# EasyEDA Pro project Cerberus_Sub_Controller_v01.eprj, board Cerberus_Sub_Controller_v01 (continued)
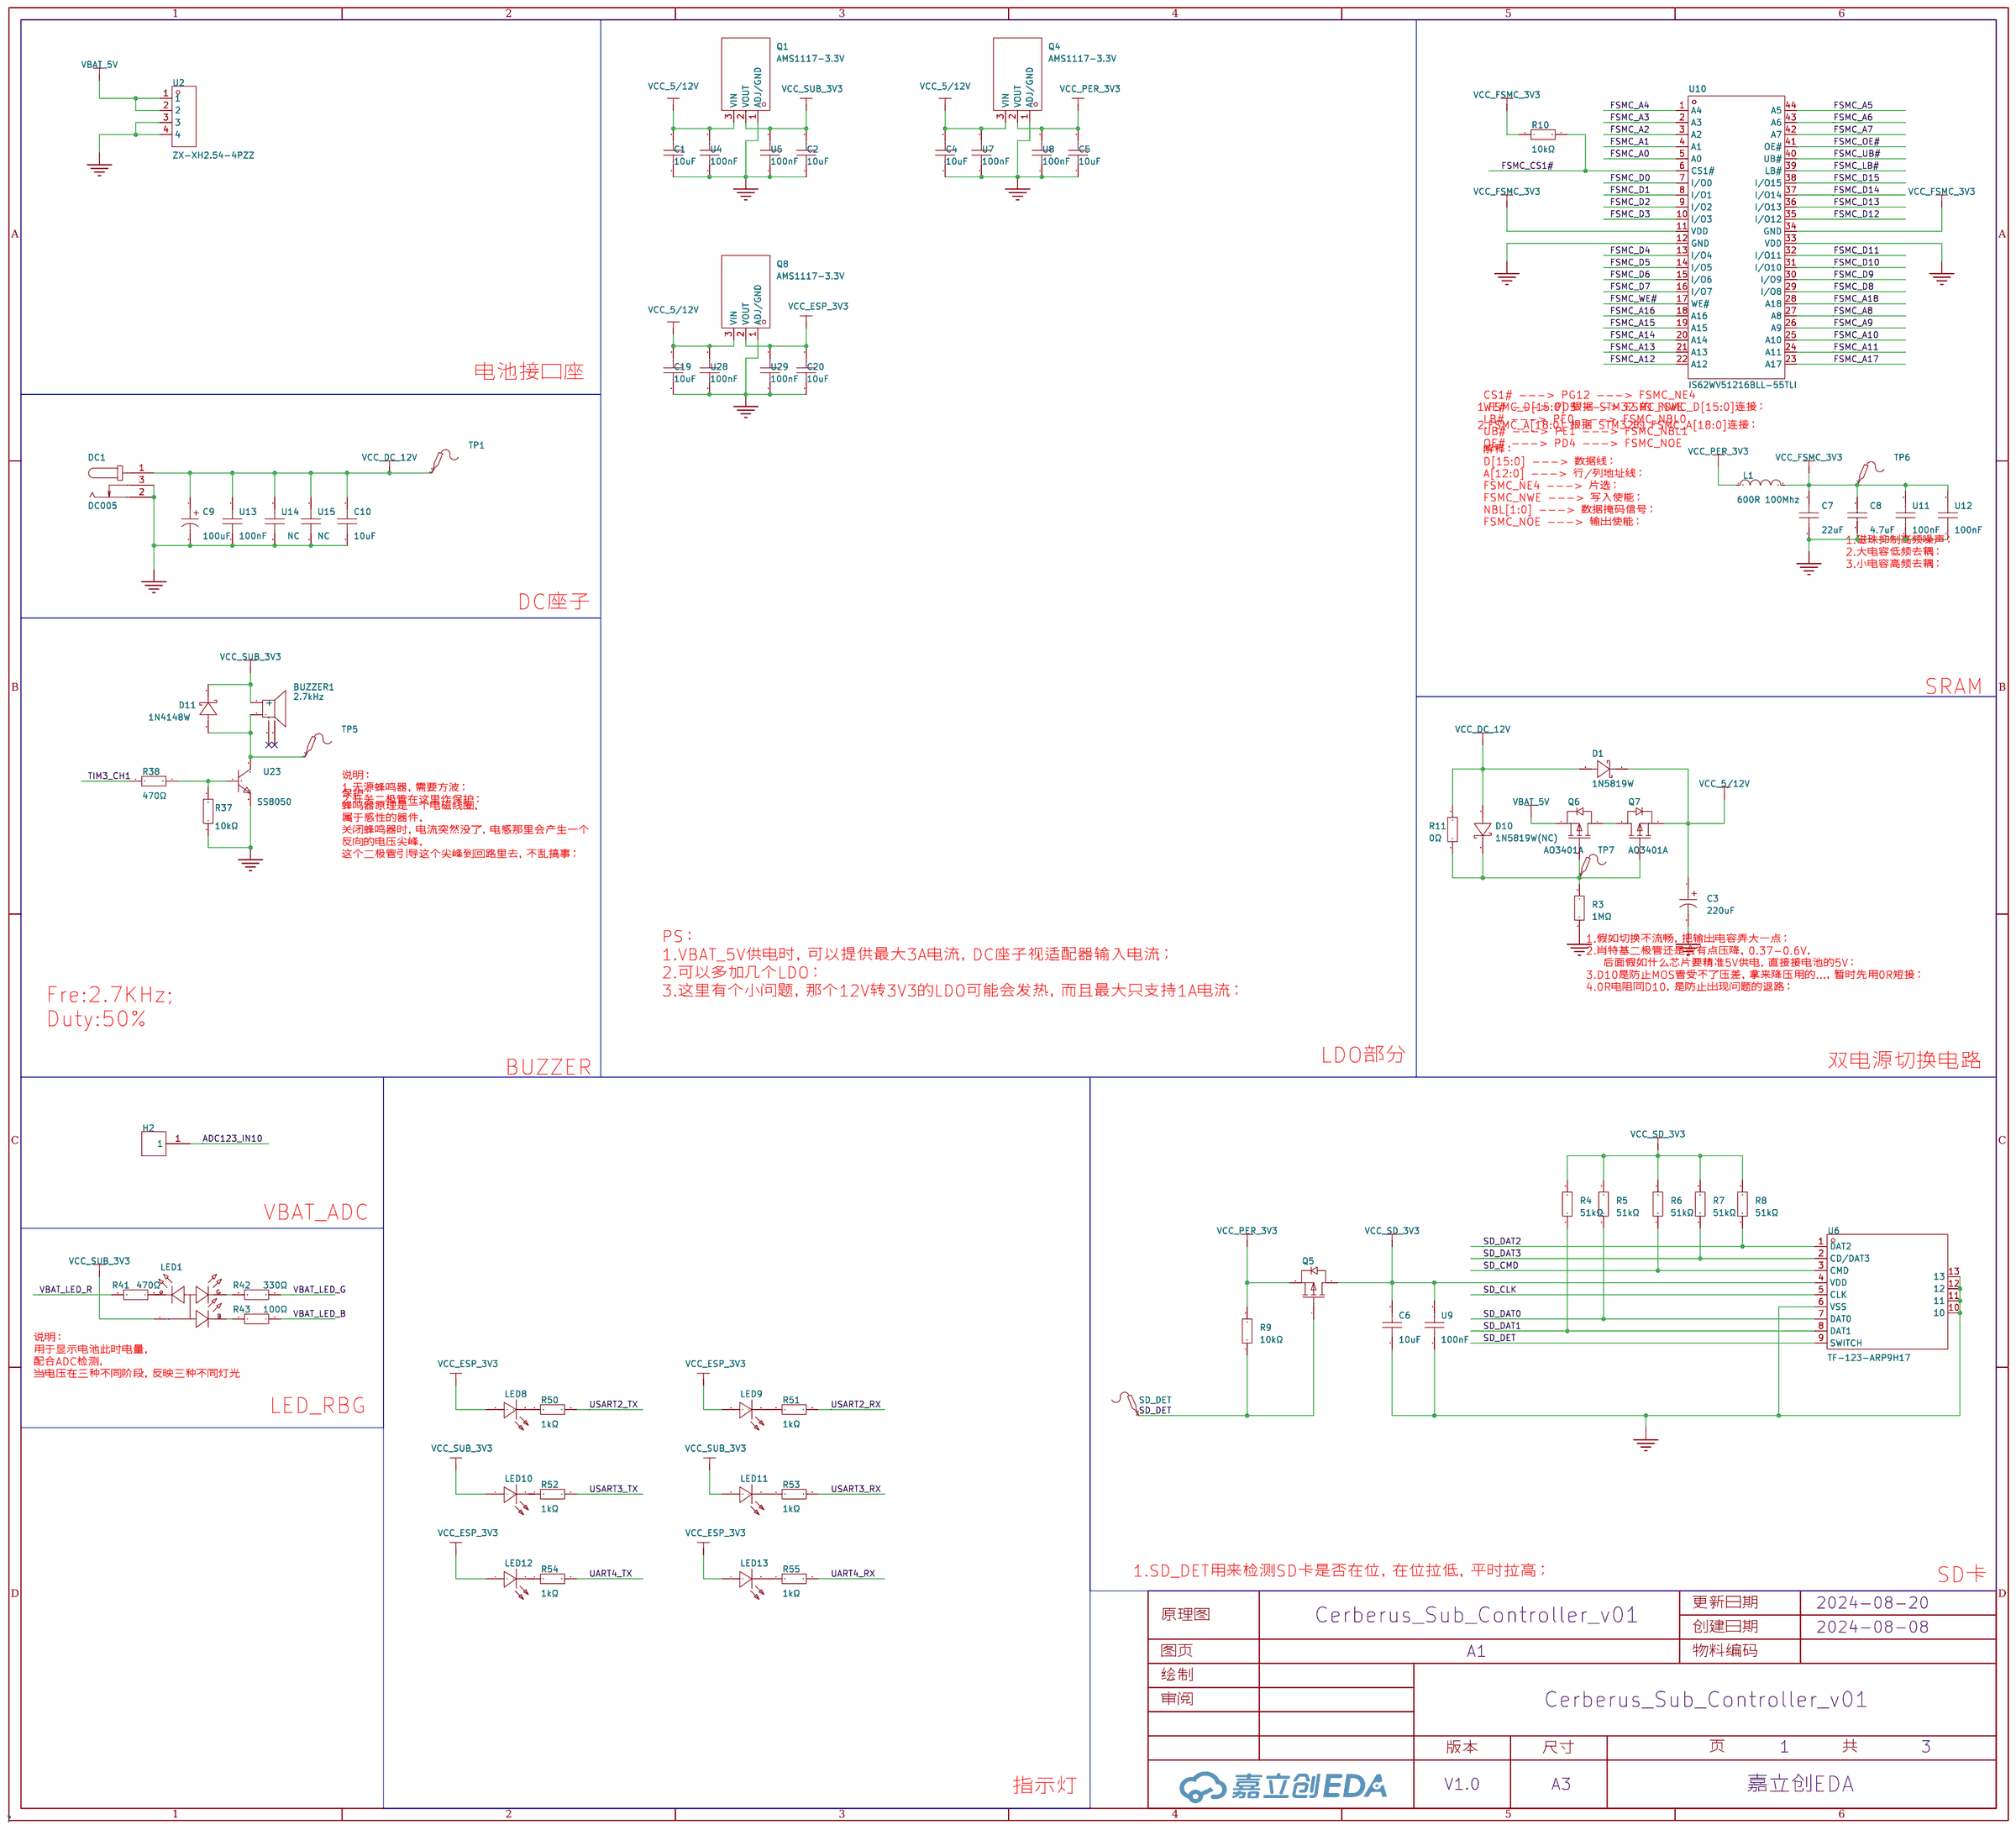
[diagram p0: A1]
## Nets (continued)
PD7: CN1.35 U24.21
PDR_ON: CN1.18 R39.1 R40.2
PE2: CN1.17 U24.22
PE3: CN1.16 U24.14
PE4: CN1.15 U24.23
PE5: CN1.14 U24.15
PE6: CN1.13 U24.24
PF6: CN2.60 U25.8
PF7: CN2.59 U25.17
PF8: CN2.58 U25.9
PF9: CN2.57 U25.18
PF11: CN2.5 U25.26
PG6: CN1.60 U24.1
PG7: CN1.59 U24.17
PG8: CN1.58 U24.2
PG9: CN1.34 U24.8
PG10: CN1.33 R42.2
PG11: CN1.32 U24.9
PG13: CN1.30 U24.10
PG14: CN1.29 R43.2
PG15: CN1.28 U24.11
SD_DET: Q5.1 R9.1 SD_DET.1 U6.9
SWCLK: CN1.47 U24.19
SWDIO: CN1.48 U24.5
VREF+: CN2.51 U25.20
$1N508: Q6.3 Q7.3
$1N7566: D10.2 MOS_G.1 Q6.1 Q7.1 R3.2 R11.1
$1N11787: BUZ_SN.1 BUZZER1.2 D11.1 U23.3
$1N11843: R37.2 R38.2 U23.1
$1N12167: BATTERY.2 R41.2
$1N12224: BATTERY.3 R42.1
$1N12304: BATTERY.4 R43.1
$1N13565: R50.1 TX2.2
$1N13573: R51.1 RX2.2
$1N13763: R52.1 TX3.2
$1N13771: R53.1 RX3.2
$1N13961: R54.1 TX4.2
$1N13969: R55.1 RX4.2
$2N431: R2.1 USB1.4
$2N434: R1.1 USB1.10
$2N1990: R12.2 U16.9
$2N2067: C11.2 U16.10
$2N2156: R13.2 U16.12
$2N2359: C14.1 U16.20
$2N2438: R14.1 U16.24
$2N2441: R15.1 U16.23
$2N3213: C18.2 U17.5
$2N5650: R33.2 U1.6
$2N5692: R34.2 U1.7
$2N6121: OPENMV4.3 R36.2
$2N6127: OPENMV4.2 R35.2
$2N7761: R57.2 U30.3
$2N9014: ESP_IO0.4 R66.2
$2N9237: ESP_RST.4 R69.2
$2N9578: H8.1 H8.3 R60.2
$2N9587: H9.1 H9.3 R61.2

Pads without a net: BUZZER1 3 4; ESP_IO0 2 3; ESP_RST 2 3; LC02 6; U1 4; U16 2 3 4 5 14 15 16 17 19 21 22; U17 2 11 12; U30 17 18 19 20 21 22; USB1 2 3 9 11

## Via types
v1: diameter 0.4, hole 0.3, Top Layer to Bottom Layer, 854 vias

## Routing (per net, layer and track width the routed paths; a pad name or vN(x,y) marks a point on that pad's centre or on a via; arc(x,y) is an arc through that point)
GND: length 12.1
  Top Layer w0.203: C18.1 50.34,17.69 U17.6 ; U17.8 48.09,16.19 v1(47.79,16.48) v1(46.52,16.48) C17.2 ; U16.11 63.11,17.18 C11.1 C12.1 63.41,14.45 R12.1
  Bottom Layer w0.381: U10.33 42.07,35.91 v1(41.66,36.32)
  vias: v1(1.02,49.01) v1(1.02,48) v1(1.02,46.73) v1(1.02,45.71) v1(1.02,44.57) v1(1.02,43.55) v1(1.02,42.41) v1(1.02,41.39) v1(1.02,40.38) v1(1.02,39.36) v1(1.02,38.22) v1(1.65,15.48) v1(1.65,11.17) v1(1.65,6.47) v1(2.29,72.63) v1(2.29,67.3) v1(2.29,62.73) v1(2.41,33.39) v1(2.41,30.98) v1(3.24,28.69) v1(3.17,25.39) v1(3.39,58.03) v1(3.43,53.84) v1(3.56,46.73) v1(3.56,39.23) v1(5.26,43.55) v1(5.26,40.87) v1(5.46,32.63) v1(5.72,73.14) v1(6.1,13.58) v1(6.86,28.69) v1(7.49,47.74) v1(7.87,53.84) v1(8,33.77) v1(8,25.52) v1(8.13,9.39) v1(8.41,43.55) v1(8.38,40.88) v1(8.89,62.09) v1(9.14,73.02) v1(9.4,78.73) v1(9.91,48.76) v1(9.91,46.73) v1(10.16,13.45) v1(10.41,38.6) v1(10.54,53.84) v1(11.05,33.39) v1(11.62,43.55) v1(11.68,48.76) v1(11.68,46.73) v1(11.94,30.47) v1(12.32,38.22) v1(12.45,73.02) v1(13.21,63.11) v1(13.46,78.73) v1(13.59,25.39) v1(14.22,31.61) v1(14.35,21.71) v1(14.99,16.88) v1(14.99,12.94) v1(14.99,9.26) v1(14.99,5.96) v1(15.24,38.47) v1(15.49,48.89) v1(15.49,46.73) v1(15.48,43.55) v1(15.49,41.27) v1(15.49,35.88) v1(15.75,73.14) v1(17.02,25.26) v1(17.53,16.12) v1(17.53,12.31) v1(17.53,8.75) v1(17.53,5.71) v1(17.78,19.68) v1(18.16,73.14) v1(18.5,66.34) v1(18.67,78.73) v1(18.8,24.37) v1(18.8,21.58) v1(18.92,29.96) v1(19.18,5.2) v1(19.43,59.3) v1(20.07,60.82) v1(20.19,67.43) v1(20.45,34.53) v1(20.45,31.74) v1(20.45,26.28) v1(20.95,73.14) v1(21.21,9.26) v1(21.34,27.3) v1(21.34,12.94) v1(21.59,70.47) v1(21.84,56.5) v1(21.97,34.53) v1(21.97,31.74) v1(22.99,73.4) v1(23.24,61.71) v1(23.49,66.34) v1(24.38,52.19) v1(24.51,50.41) v1(24.64,74.41) v1(24.64,48.76) v1(24.64,43.68) v1(24.64,39.74) v1(24.64,35.8) v1(24.64,32.38) v1(24.77,27.55) v1(24.77,25.9) v1(24.77,7.74) v1(24.89,11.8) v1(24.96,78.73) v1(25.02,66.34) v1(25.27,13.07) v1(25.4,9.64) v1(26.29,59.3) v1(26.67,74.92) v1(26.8,69.46) v1(26.8,67.55) v1(26.8,65.52) v1(27.56,57.39) v1(27.56,55.62) v1(27.56,53.97) v1(28.32,50.51) v1(28.83,9.64) v1(29.02,78.73) v1(28.96,69.46) v1(28.95,67.55) v1(28.97,65.52) v1(29.21,59.3) v1(29.72,60.95) v1(30.1,57.39) v1(30.1,55.62) v1(30.1,53.97) v1(30.23,36.82) v1(30.23,34.66) v1(30.23,33.14) v1(30.73,44.95) v1(30.73,23.48) v1(30.73,21.07) v1(30.73,16.37) v1(30.73,14.85) v1(30.86,69.46) v1(30.87,67.55) v1(30.89,65.52) v1(31.5,60.95) v1(31.5,42.03) v1(31.5,40.63) v1(32.64,31.74) v1(32.64,30.98) v1(33.02,60.31) v1(33.36,69.86) v1(33.78,61.08) v1(34.23,78.73) v1(34.42,47.11) v1(34.42,46.09) v1(34.42,23.1) v1(34.42,20.31) v1(34.93,25.9) v1(35.05,14.72) v1(35.05,12.18) v1(35.05,9.64) v1(35.43,69.59) v1(35.43,41.9) v1(35.56,7.99) v1(35.81,45.71) v1(35.94,48.5) v1(36.45,6.97) v1(36.58,14.72) v1(36.58,12.18) v1(36.58,9.64) v1(36.83,56.5) v1(36.83,21.58) v1(36.83,20.44) v1(36.96,18.15) v1(37.08,7.99) v1(38.23,70.09) v1(38.23,59.3) v1(38.23,31.74) v1(38.42,78.73) v1(39.12,49.65) v1(39.12,41.65) v1(39.12,30.85) v1(39.24,51.68) v1(39.62,58.16) v1(39.62,56.38) v1(39.62,54.6) v1(39.75,7.99) v1(39.88,17.64) v1(40,40.76) v1(40.39,24.37) v1(41.02,51.93) v1(41.28,50.03) v1(41.4,70.09) v1(41.4,43.04) v1(41.4,6.97) v1(41.4,5.71) v1(41.66,45.84) v1(41.78,13.07) v1(42.48,78.73) v1(42.54,50.54) v1(42.8,61.33) v1(43.31,48.12) v1(43.81,55.11) v1(43.81,49.27) v1(43.94,13.07) v1(44.07,57.01) v1(44.45,69.84) v1(44.58,15.99) v1(44.58,14.72) v1(44.58,6.97) v1(44.58,5.71) v1(44.66,21.02) v1(44.96,53.97) v1(44.96,40.76) v1(44.96,39.11) v1(44.96,38.09) v1(44.96,16.75) v1(45.85,58.41) v1(46.61,13.45) v1(46.74,70.09) v1(46.74,46.34) v1(47.69,78.73) v1(48.64,7.99) v1(49.02,70.35) v1(49.15,61.08) v1(49.53,25.26) v1(49.91,6.97) v1(50.29,5.45) v1(51.44,73.14) v1(51.44,20.82) v1(51.56,51.17) v1(51.56,7.99) v1(52.07,24.88) v1(52.07,14.59) v1(52.32,59.05) v1(52.32,56.89) v1(52.32,54.6) v1(52.32,52.44) v1(52.51,78.73) v1(52.45,28.69) v1(52.45,5.83) v1(52.58,66.67) v1(52.58,34.41) v1(52.58,31.99) v1(52.71,71.87) v1(53.09,74.16) v1(53.09,12.56) v1(53.09,10.28) v1(53.72,50.16) v1(53.86,35.91) v1(54.48,24.88) v1(54.48,22.47) v1(54.48,20.82) v1(54.48,17.77) v1(54.74,15.87) v1(54.86,72.25) v1(54.86,69.97) v1(54.86,7.99) v1(54.99,12.56) v1(54.99,10.28) v1(55.37,29.96) v1(55.5,74.16) v1(55.88,34.79) v1(56.01,5.83) v1(56.13,55.36) v1(56.13,46.85) v1(56.51,70.6) v1(56.51,38.98) v1(56.58,78.73) v1(57.28,54.85) v1(57.4,72.25) v1(57.53,26.91) v1(57.66,74.41) v1(57.66,61.2) v1(57.66,59.3) v1(57.66,52.95) v1(57.78,57.01) v1(58.67,73.4) v1(58.93,5.83) v1(59.31,15.1) v1(59.94,29.2) v1(59.94,18.15) v1(60.36,22.19) v1(60.45,71.62) v1(60.45,13.58) v1(60.71,16.37) v1(60.96,73.4) v1(60.96,11.55) v1(61.34,33.01) v1(61.34,31.49) v1(61.79,78.73) v1(61.85,21.45) v1(61.85,20.31) v1(61.98,5.83) v1(62.99,21.45) v1(62.99,20.31) v1(62.99,13.45) v1(63.25,73.65) v1(63.75,55.36) v1(63.75,11.42) v1(64.13,66.35) v1(64.36,22.19) v1(64.52,57.01) v1(64.77,13.45) v1(65.28,60.31) v1(65.28,5.83) v1(65.41,74.28) v1(65.79,24.79) v1(65.91,18.02) v1(66.04,28.06) v1(66.17,66.35) v1(66.17,11.17) v1(66.17,8.75) v1(66.29,20.98) v1(66.42,42.41) v1(66.42,37.71) v1(66.55,44.19) v1(66.55,13.45) v1(66.68,61.08) v1(66.93,70.09) v1(66.93,68.7) v1(66.93,32.88) v1(66.93,29.83) v1(67.06,57.9) v1(67.06,52.31) v1(67.06,50.28) v1(67.06,47.87) v1(67.31,74.79) v1(68.64,78.73) v1(68.58,5.83) v1(71.38,22.09) v1(71.5,58.28) v1(72.52,29.07) v1(72.52,5.83) v1(72.71,78.73) v1(73.41,17.77) v1(73.41,14.59) v1(73.66,74.16) v1(73.66,72.25) v1(73.66,26.91) v1(74.55,29.07) v1(74.56,22.03) v1(74.8,35.04) v1(74.8,32.38) v1(75.06,65.01) v1(75.69,53.84) v1(75.69,50.54) v1(75.76,63.24) v1(75.95,44.19) v1(76.07,37.96) v1(76.96,74.16) v1(76.96,72.25) v1(76.96,69.71) v1(77.47,17.77) v1(77.47,14.59) v1(77.6,35.04) v1(77.6,32.38) v1(77.91,78.73) v1(78.23,8.37) v1(78.23,5.83) v1(78.87,27.68) v1(78.87,25.14) v1(78.99,67.75) v1(79.25,62.98) v1(80.14,69.86) v1(80.26,60.76) v1(80.26,58.85) v1(81.28,74.16) v1(81.28,72.25) v1(81.41,27.42) v1(82.11,78.6) v1(82.68,67.75) v1(82.8,62.03) v1(82.8,60.12) v1(84.84,41.01) v1(84.84,39.23) v1(84.96,74.16) v1(84.96,72.25) v1(84.96,67.24) v1(84.96,65.33) v1(84.96,63.17) v1(84.96,61.27) v1(84.96,59.62) v1(84.96,57.71) v1(85.72,23.36) v1(86.14,21.2) v1(86.17,78.6) v1(86.49,29.83) v1(86.93,28.01) v1(87,31.99) v1(86.95,26.11) v1(87.11,55.99) v1(87.63,61.9) v1(87.63,60) v1(87.83,21.2) v1(89.01,55.99) v1(90.93,18.91) v1(91.06,34.15) v1(91.06,28.69) v1(91.06,23.1) v1(91.19,61.84) v1(91.19,57.9) v1(91.19,53.71) v1(91.19,50.03) v1(93.85,61.84) v1(93.85,57.9) v1(93.85,53.71) v1(93.85,50.03) v1(93.85,45.33) v1(93.85,40) v1(93.85,34.15) v1(93.85,28.69) v1(93.85,23.1) v1(93.85,18.91)
VBAT: length 43.5
  Top Layer w0.203: v1(77.72,64) 77.72,65.65 66.68,76.7
  POWER w0.381: v1(60.45,50.16) v1(64.52,50.16)
  Bottom Layer w0.203: v1(64.52,50.16) 65.66,50.16 66.17,49.65 68.2,49.65 77.72,59.17 v1(77.72,64)
VCC_5/12V: length 14.9
  POWER w0.762: OPENMV4.1 22.48,69.2 24.26,67.43 v1(24.26,63.24)
  vias: v1(26.22,63.11) v1(26.22,61.2) v1(48.39,63.24) v1(50.61,63.24) v1(50.61,61.33) v1(72.01,63.24) v1(74.36,63.24) v1(74.36,61.33) v1(77.56,55.87) v1(78.36,56.63) v1(78.64,55.87) v1(79.12,38.85) v1(79.25,57.27) v1(79.81,38.85) v1(80,55.87) v1(80.26,37.84) v1(80.48,56.41) v1(80.72,38.85) v1(81.03,57.01) v1(81.03,37.84) v1(81.34,55.87) v1(81.45,38.85) v1(81.91,56.5) v1(82.42,57.01) v1(82.57,55.87) v1(83.19,56.5) v1(83.82,57.14) v1(83.97,55.87) v1(86.11,49.27) v1(86.23,47.61) v1(87.12,49.27) v1(87.12,47.63) v1(87.96,49.27)
VCC_DC_12V:
  vias: v1(80.26,20.94) v1(80.56,34.56) v1(81.14,20.94) v1(81.66,33.64) v1(82,20.94) v1(82.81,20.94) v1(83.05,33.64) v1(83.76,35.39) v1(84.44,33.65) v1(85.53,31.74) v1(85.53,29.88) v1(85.53,28.01) v1(85.53,26.15) v1(85.89,33.64) v1(86.87,34.56)
VCC_ESP_3V3: length 114.2
  POWER w0.381: 25.78,32.11 22.49,28.82 v1(13.88,28.82) ; v1(16,64.95) 14.41,66.54 10.29,66.54 ; v1(5.46,56.27) 13.35,56.27 15.88,58.79
  POWER w0.762: 18.54,64.12 18.54,61.46 15.88,58.79 15.88,54.03 v1(15.94,53.97) 15.94,52.63 ; 15.94,52.63 15.94,50.13 v1(15.91,50.1) ; 15.94,52.63 v1(15.11,51.81) v1(15.11,50.1)
  POWER w1.016: 19.69,62.86 25.78,56.76 25.78,21.2 22.76,18.18 v1(22.76,18.15) v1(22.76,7.48) 22.76,7.1
  Bottom Layer w0.508: v1(21.5,64.76) 21.31,64.95 U29.2 v1(16,64.95)
  vias: v1(10.29,66.57) v1(15.94,55.87) v1(15.91,51.81) v1(20.53,64.76) v1(22.59,64.76) v1(22.76,14.55) v1(22.76,10.9)
VCC_FSMC_3V3: length 33.9
  Bottom Layer w0.381: L1.2 47.18,56.63 v1(45.54,56.63)
  Bottom Layer w0.508: 47.38,39.25 49.92,36.71 U10.11 ; 47.38,39.25 R10.1 47.37,47.75 L1.2 ; 47.38,39.25 47.38,37.59 46.5,36.71 U10.34
VCC_PER_3V3: length 50.8
  Top Layer w0.254: R24.2 44.65,22.39 v1(44.07,22.98)
  Top Layer w0.381: C17.1 v1(46.52,15.39)
  POWER w0.381: 49.51,15.39 v1(47.79,15.39) v1(46.52,15.39) 41.74,15.39 v1(40.64,16.49) ; 49.51,15.39 v1(49.71,15.19) ; 49.51,15.39 49.71,15.6 v1(49.71,15.69) ; v1(50.63,18.72) v1(50.63,19.43) 49.75,20.31 43.05,20.31
  POWER w0.762: 41.53,8.75 42.54,9.77 v1(42.54,9.9) ; v1(49.02,9.86) 47.66,8.5 40.77,8.5 39.88,9.39 39.88,16.88 ; v1(46.56,64.76) 47.75,64.76 v1(49.66,66.67) 50.79,66.67 v1(51.05,66.4)
  Bottom Layer w0.508: v1(45.75,64.76) 45.56,64.95 U8.2 C5.2
  vias: v1(40.51,21.59) v1(40.51,20.94) v1(40.51,20.18) v1(44.77,64.76) v1(44.83,60.82) v1(44.83,60.19) v1(44.83,59.55) v1(45.72,60.82) v1(45.72,60.19) v1(45.72,59.55) v1(46.61,60.82) v1(46.61,60.19) v1(46.61,59.55) v1(47.37,58.22)
VCC_SD_3V3: length 18
  Top Layer w0.508: Q5.3 45.27,65.65 C6.2 ; 44.96,65.65 43.37,65.65 U9.2 43,65.66 U6.4
  POWER w0.762: v1(39.24,65.65) 36.45,68.44
  Bottom Layer w0.762: R8.2 R7.2 R6.2 R5.2 R4.2
  vias: v1(35.05,67.81) v1(35.7,67.81)
VCC_SUB_3V3: length 106.6
  POWER w0.381: v1(59.82,54.14) 59.77,54.09 55.75,54.09 52.42,50.76 v1(52.42,47.74) ; 68.71,14.21 61.38,14.21 58.37,17.22 ; v1(78.99,66.35) 78.93,66.41 v1(69.85,66.41) ; v1(78.99,66.35) v1(82.68,66.35) v1(82.68,64.49) ; v1(78.99,66.35) 78.87,66.22 v1(78.87,64.49) ; 58.37,17.22 58.37,22.52 56.39,24.5 v1(56.1,24.5) ; 58.37,17.22 v1(56.61,18.99) ; v1(73.34,44.46) 73.34,45.27 70.1,48.5 ; 67.82,21.2 v1(66.42,19.8) 66.31,19.69 v1(64.36,19.69) ; 67.06,15.61 v1(62.32,15.61) 61.61,16.32 v1(61.61,18.94) ; 68.33,27.42 68.33,27.39 v1(66.71,25.77)
  POWER w0.762: 80.77,29.83 80.26,30.34 73.15,30.34 69.34,34.15 ; 69.72,14.85 67.44,12.56 59.06,12.56 57.62,11.12 57.62,10.15 57.63,10.14 v1(57.63,10.11) 57.63,7.61 v1(57.62,7.61)
  Bottom Layer w0.508: Q1.2 69.07,64.95 U5.2 C2.2
  vias: v1(64.22,54.14) v1(64.22,53.33) v1(68.07,60.7) v1(68.45,66.41) v1(69.22,60.7) v1(70.23,60.7) v1(76.58,30.3) v1(80.77,30.85) v1(80.77,29.74)
ADC123_IN10: length 12.3
  Top Layer w0.203: CN2.55 31.88,52.53 30.89,51.55 VBAT_ADC.1
D+: length 7.9
  Top Layer w0.203: 86.52,69.08 87.52,70.08 USB1.8 ; 86.52,69.08 83.45,69.08 U1.1 ; 86.52,69.08 USB1.6
D-: length 10.3
  Top Layer w0.203: 81.41,69.86 81.41,68.82 81.66,68.57 88.16,68.57 USB1.5 88.78,68.58 89.03,68.82 89.03,69.33 88.78,69.58 USB1.7
ESP_ADC: length 20.6
  Top Layer w0.203: v1(3.56,50.79) 3.56,49.14 7.11,45.58 H7.2
ESP_IO0: length 17.1
  Top Layer w0.203: ESP_IO0.1 5.69,30.19 8.64,33.14 ; 8.64,33.14 8.64,29.45 9.4,28.69 v1(12.32,28.69) ; 8.64,33.14 9.53,34.03 9.53,35.8
  vias: v1(9.49,35.87)
ESP_IO2: length 14.1
  Top Layer w0.203: H7.3 16.13,43.04 ESP_IO2.1 11.49,38.28 v1(11.49,35.87)
ESP_IO4: length 16.3
  Top Layer w0.203: H7.4 20.95,40.38 v1(14.73,40.38)
  Bottom Layer w0.203: v1(14.73,40.38) 10.64,40.38 7.49,37.23 U30.13
ESP_IO5: length 20.7
  Bottom Layer w0.203: 11.3,32.5 7.51,32.5 5.49,34.52 U30.14 ; v1(11.45,32.5) 17.02,32.5 21.08,36.57 H7.5
ESP_IO16: length 15.7
  Top Layer w0.203: H7.1 8.89,48.12 7.49,49.52 v1(7.49,51.04)
ESP_RST: length 18.5
  Bottom Layer w0.203: U30.1 1.49,57.56 v1(3.46,59.53) 8.95,65.02 R68.1
ESP_RX0: length 7.6
  Bottom Layer w0.203: U30.15 3.49,29.64 R61.1
ESP_RX0_E: length 6.1
  Bottom Layer w0.203: H9.4 9.4,17.9 9.4,15.61 ET|ER|G.2
ESP_SPI_CLK: length 19.3
  Top Layer w0.203: v1(9.49,50.98) 10.95,49.52 26,49.52 v1(27.53,51.04)
ESP_SPI_CS: length 74.4
  Top Layer w0.203: v1(43.81,56) 55.25,56 v1(57.78,58.54)
  Bottom Layer w0.203: U30.10 13.49,34.52 13.74,34.28 17.02,34.28 18.54,35.8 18.54,57.39 19.94,58.79 41.02,58.79 v1(43.81,56) ; R67.1 61.22,58.54 v1(57.78,58.54)
ESP_SPI_MISO: length 16.7
  Top Layer w0.203: v1(27.53,52.69) 13.2,52.69 v1(11.49,50.98)
ESP_SPI_MOSI: length 56
  Top Layer w0.203: v1(57.66,60.31) 55.07,57.73 44.12,57.73 v1(43.81,58.03)
  Bottom Layer w0.203: R64.1 61.34,60.31 v1(57.66,60.31) ; U30.7 13.49,55.27 18.03,59.81 42.04,59.81 v1(43.81,58.03)
ESP_TX0: length 7.3
  Bottom Layer w0.203: U30.16 1.49,28.84 R60.1
ESP_TX0_E: length 5.6
  Bottom Layer w0.203: H8.4 5.08,19.17 6.6,17.64 ET|ER|G.1
FSMC_A0: length 13.9
  Bottom Layer w0.203: v1(64.22,50.94) 64.02,50.94 54.6,41.51 U10.5
FSMC_A1: length 11.7
  SN_IMT w0.381: v1(59.82,51.81) 54.61,46.6 v1(54.61,42.28)
FSMC_A2: length 13.6
  Bottom Layer w0.203: v1(64.22,51.73) 63.94,51.73 55.31,43.11 U10.3
FSMC_A3: length 12.3
  Bottom Layer w0.203: U10.2 53.39,43.91 53.03,44.26 53.03,45.91 v1(59.69,52.57)
FSMC_A4: length 12.9
  Bottom Layer w0.203: v1(64.26,52.57) 56.41,44.71 54.64,44.71
FSMC_A5: length 20.1
  SN_IMT w0.381: v1(59.44,53.33) 50.82,44.71 v1(42.86,44.71)
FSMC_A6: length 6.2
  Top Layer w0.203: v1(38.99,45.46) 37.5,45.46 CN2.38
  Bottom Layer w0.203: U10.43 42.31,43.91 40.77,45.46 v1(38.99,45.46)
FSMC_A7: length 10.2
  Bottom Layer w0.203: v1(33.53,45.33) 34.8,45.33 35.18,44.95 40.39,44.95 42.22,43.11 U10.42
FSMC_A8: length 15.9
  POWER w0.381: v1(37.97,44.44) 38.86,44.44 41.02,42.28 41.02,34.41 42.86,32.57 v1(42.86,31.11)
FSMC_A9: length 20.3
  Top Layer w0.203: v1(35.94,36.44) 35.94,40.38 36.02,40.45 36.02,43.47 34.93,44.57 33.01,44.57 CN2.35
  SN_NRM w0.381: v1(35.94,36.44) 36.32,36.44 v1(41.53,31.23)
  Bottom Layer w0.203: v1(41.53,31.23) 41.53,30.76 41.98,30.31 U10.26
FSMC_A10: length 21.6
  Top Layer w0.203: v1(35.94,44.44) 35.94,44.06 36.26,43.73 CN2.34
  POWER w0.381: v1(40.77,30.22) 40.77,30.75 34.67,36.81 v1(34.67,39.36)
  SN_NRM w0.381: v1(35.31,43.17) 34.67,42.53 v1(34.67,39.36)
  Bottom Layer w0.203: v1(35.94,44.44) 35.94,43.81 v1(35.31,43.17) ; v1(40.77,30.22) 41.47,29.51 U10.25
FSMC_A11: length 27.6
  POWER w0.381: v1(42.86,28.71) 36.68,28.71 35.81,29.58 31.37,29.58 30.86,30.09 30.86,42.92 31.62,43.68 v1(32.77,43.68)
FSMC_A12: length 23.6
  SN_IMT w0.381: v1(54.17,27.91) 39.39,27.91 v1(33.15,34.15)
FSMC_A13: length 18.8
  SN_IMT w0.381: v1(54.17,28.71) 50.76,32.12 40.89,32.12 39.62,33.39 37.44,33.39 v1(37.38,33.33)
FSMC_A14: length 22.8
  SN_NRM w0.381: v1(54.17,29.51) 38.3,29.51 34.54,33.26 33.05,33.26 v1(32.98,33.33)
FSMC_A15: length 17.8
  SN_NRM w0.381: v1(37.38,32.53) 37.41,32.5 39.37,32.5 41.66,30.22 54.07,30.22 v1(54.17,30.31)
FSMC_A16: length 18.1
  SN_NRM w0.381: v1(37.97,35.68) 42.8,35.68 47.36,31.11 v1(54.17,31.11)
FSMC_A17: length 23.5
  Top Layer w0.203: v1(30.1,35.8) 32.91,35.8 CN2.13
  SN_IMT w0.381: v1(30.1,35.8) 29.97,35.8 29.59,35.42 29.59,30.47 32.89,27.17 v1(40.77,27.17)
  Bottom Layer w0.203: v1(40.77,27.17) 41.51,27.91 U10.23
FSMC_A18: length 10.9
  Top Layer w0.203: v1(35.69,34.15) 35.43,34.41 35.43,34.81 35.56,34.94 CN2.12
  Bottom Layer w0.203: v1(35.69,34.15) 39.12,34.15 41.36,31.91 U10.28
FSMC_CS1#: length 22.2
  Bottom Layer w0.203: R10.2 48.89,41.15 49.4,40.63 54.09,40.63 U10.6 54.82,40.71 55.63,41.52 62.99,41.52 v1(63.63,42.15)
FSMC_D0: length 23.1
  Top Layer w0.203: v1(54.17,39.91) 49.17,34.92 v1(38.75,34.92)
  SN_IMT w0.381: v1(38.75,34.92) v1(33.15,34.92)
FSMC_D1: length 19
  Top Layer w0.203: v1(54.17,39.11) 48.96,33.9 37.62,33.9 37.38,34.14
FSMC_D2: length 5.7
  Bottom Layer w0.203: U10.9 59.59,38.31 v1(59.82,38.09)
FSMC_D3: length 10.3
  Bottom Layer w0.203: 64.26,38.09 63.68,37.51 U10.10
  vias: v1(64.22,38.14)
FSMC_D4: length 19.4
  SN_NRM w0.381: v1(37.97,42.92) 38.99,42.92 46.79,35.11 v1(54.17,35.11)
FSMC_D5: length 27.3
  SN_NRM w0.381: v1(32.98,42.94) 33,42.92 33.78,42.92 34.67,43.81 46.74,43.81 54.86,35.68 54.86,35.01 v1(54.17,34.31)
FSMC_D6: length 20.4
  SN_IMT w0.381: v1(37.47,42.15) 41.66,37.96 v1(41.66,37.71)
  SN_NRM w0.381: v1(54.17,33.51) 45.85,33.51 v1(41.66,37.71)
FSMC_D7: length 25.1
  SN_IMT w0.381: v1(54.17,32.71) 42.21,32.71 33.02,41.91 v1(33.02,42.03)
FSMC_D8: length 12.2
  POWER w0.381: v1(37.34,41.27) 38.1,41.27 40.39,38.98 40.39,33.6 v1(41.28,32.71)
  Bottom Layer w0.203: U10.29 v1(41.28,32.71)
FSMC_D9: length 14.1
  POWER w0.381: v1(32.64,41.39) 33.66,41.39 39.62,35.42 v1(39.62,34.41)
  Bottom Layer w0.203: U10.30 40.52,33.51 v1(39.62,34.41)
FSMC_D10: length 9
  SN_IMT w0.381: v1(37.34,40.5) 41.02,36.82 41.02,35.3 v1(41.91,34.41)
  Bottom Layer w0.203: v1(41.91,34.41) 42.76,34.41 U10.31
FSMC_D11: length 12.2
  Top Layer w0.203: v1(35.43,40.63) 33.07,40.63 CN2.25
  SN_IMT w0.381: v1(39.75,36.31) v1(35.43,40.63)
  Bottom Layer w0.203: U10.32 40.95,35.11 v1(39.75,36.31)
FSMC_D12: length 7
  Top Layer w0.203: CN2.24 37.38,39.74 38.86,39.74 41.53,37.07 42.54,37.07 v1(43.05,37.58)
FSMC_D13: length 9.7
  SN_NRM w0.381: v1(33.15,37.33) 34.16,38.34 v1(42.42,38.34)
FSMC_D14: length 6.3
  Bottom Layer w0.203: v1(37.59,36.57) 40.14,39.11 U10.37
FSMC_D15: length 10.8
  Bottom Layer w0.203: U10.38 36.75,39.91 v1(33.4,36.57)
FSMC_LB#: length 19.6
  Top Layer w0.203: 59.77,46.98 57.02,46.98 54.23,44.19 v1(52.45,44.19)
  Top Layer w0.381: 59.77,46.98 CN1.20
  SN_IMT w0.381: v1(52.45,44.19) 51.31,43.04 v1(46.35,43.04)
  SN_NRM w0.381: v1(46.35,43.04) 44.02,40.71 v1(42.86,40.71)
FSMC_OE#: length 18
  Top Layer w0.203: v1(52.83,42.31) 55.41,39.73 CN1.38
  SN_IMT w0.381: v1(42.86,42.31) v1(52.83,42.31)
  vias: v1(59.56,39.74)
FSMC_UB#: length 23.6
  SN_IMT w0.381: v1(64.22,46.94) 58.79,41.51 v1(42.86,41.51)
FSMC_WE#: length 13.3
  SN_IMT w0.381: v1(64.26,39.74) 56.43,31.91 v1(54.17,31.91)
I2C1_SCL: length 68.3
  Top Layer w0.203: 59.82,46.14 61.85,46.14 62.05,45.93 62.05,30.03 57.66,25.64 v1(57.66,24.49) ; v1(57.66,16.88) 57.1,16.32 R20.2
  POWER w0.381: v1(60.45,46.09) 57.91,46.09 56.01,48 v1(56.01,51.3)
  Bottom Layer w0.203: v1(56.01,51.3) 56.01,54.58 arc(55.9,54.85) 55.63,54.97 55.32,54.97 arc(54.94,55.35) 55.32,55.73 55.63,55.73 arc(55.9,55.84) 56.01,56.11 56.01,63.72 CN4.2 ; v1(57.66,16.88) v1(57.66,24.49) R17.1 60.91,24.5 R15.2
I2C1_SDA: length 68
  Top Layer w0.203: R21.2 60.82,25.77 v1(61.98,25.77) 63.25,27.04 arc(63.3,27.18) 63.44,27.23 arc(63.57,27.29) 63.63,27.42 63.63,27.8 arc(63.57,27.94) 63.44,27.99 arc(63.3,28.05) 63.25,28.18 63.25,28.56 arc(63.3,28.7) 63.44,28.76 arc(63.57,28.81) 63.63,28.95 63.63,29.33 arc(63.57,29.46) 63.44,29.52 arc(63.3,29.57) 63.25,29.71 63.25,29.89 63.04,30.09 62.81,30.09 62.61,30.29 62.61,45.93 62.81,46.14 64.22,46.14
  POWER w0.381: v1(56.64,51.55) 56.64,48.25 58.17,46.73 61.98,46.73 62.61,46.09 v1(64.64,46.09)
  Bottom Layer w0.203: CN4.1 62.46,67.68 60.83,67.68 56.64,63.49 v1(56.64,51.55) ; v1(61.98,25.77) R16.1
LC02_CS: length 37.3
  Bottom Layer w0.203: v1(33.02,38.98) 30.23,38.98 29.21,37.96 29.21,20.82 31.12,18.91 41.66,18.91 42.42,18.15 R32.1
LC02_CS_R: length 12
  Bottom Layer w0.203: LC02.5 46.63,18.43 45.97,17.77 44.32,17.77 43.31,16.75 43.31,15.87 R32.2 R28.1 R29.2
LC02_RXD: length 13.2
  Bottom Layer w0.203: LC02.4 47.63,18.5 48.26,17.88 48.26,11.93 48.01,11.67 44.59,11.67 R31.2 R27.1
LC02_TXD: length 9.4
  Bottom Layer w0.203: R30.2 R26.1 48.63,11.8 LC02.3
LIS_CS: length 6.2
  Top Layer w0.203: R22.1 R23.2 54.22,16.19 U17.3
LIS_SCL: length 5.6
  Top Layer w0.203: R20.1 55.74,15.1 R18.1 55.62,15.19 U17.1
LIS_SDA: length 7.1
  Top Layer w0.203: U17.4 52.18,16.69 R19.1 55.74,21.56
MPU6050_AUX_CL: length 6.7
  Top Layer w0.203: U16.7 61.11,17.92 58.29,15.1 56.61,15.1 R18.2
MPU6050_AUX_DA: length 4
  Top Layer w0.203: U16.6 57.17,19.69 R19.2
MPU6050_INT: length 38.6
  Top Layer w0.203: v1(45.59,31.11) 50.29,26.41 MPU_INT.1 50.29,22.54 R13.1
  POWER w0.381: v1(37.47,52.57) 42.93,52.57 44.45,51.04 44.45,46.47 45.59,45.33 v1(45.59,31.11)
PA0: length 80.6
  Top Layer w0.203: G|R4|T4.3 v1(16.85,7.36) ; 37.38,50.14 37.36,50.16 v1(35.69,50.16) ; 33.15,57.52 30.48,60.19 R35.1
  Bottom Layer w0.203: v1(16.85,7.36) 17.4,7.36 28.32,18.28 28.32,48.38 29.59,49.65 35.31,49.65 35.69,50.03 v1(35.69,50.16) 35.69,54.47 33.14,57.02 v1(33.14,57.52)
PA1: length 77.2
  Top Layer w0.203: v1(31.88,57.52) 30.86,58.54 R36.1 ; R55.2 12.82,10.87 9.3,7.36 G|R4|T4.2
  Bottom Layer w0.203: v1(31.88,57.52) 34.93,54.47 34.93,50.66 34.42,50.16 v1(32.89,50.16) 29.34,50.16 27.56,48.38 27.56,20.56 17.86,10.87 v1(16.81,10.87)
PA2: length 65.7
  Top Layer w0.203: v1(29.97,48.63) 29.08,47.74 29.08,28.06 23.88,22.85 H9.2
  Bottom Layer w0.203: v1(16.89,18.02) 16.64,18.02 13.21,21.45 ; v1(29.97,48.63) 30.48,49.14 37.08,49.14 v1(37.34,49.39) ; NOREF.3 13.21,13.07 13.21,21.45 ; 13.21,21.45 H9.2
PA3: length 73.3
  Top Layer w0.203: R51.2 16.81,14.34 12.89,14.34 10.1,11.55 NOREF.2 ; H8.2 6.73,24.5 13.59,24.5 14.73,23.36 23.62,23.36 28.57,28.31 28.57,48.12 29.84,49.39 32.92,49.39 CN2.47
  Bottom Layer w0.203: NOREF.2 7.87,12.82 7.87,20.06 H8.2
PA4: length 71
  SN_IMT w0.381: U25.12 45.59,8.88 45.59,22.85 v1(48.13,25.39)
  POWER w0.381: v1(53.09,50.41) 53.09,46.47 53.47,46.09 53.47,37.2 v1(51.94,35.68)
  SN_NRM w0.381: v1(53.09,50.41) 53.09,50.8 51.95,51.93 45.34,51.93 41.91,48.5 v1(37.59,48.5)
  Bottom Layer w0.203: v1(48.13,25.39) 51.94,29.2 v1(51.94,35.68)
PA5: length 50.8
  SN_NRM w0.381: U25.21 26.8,4.82 26.8,46.34 28.45,48 32.13,48 v1(32.64,48.5)
PA6: length 50.6
  Top Layer w0.203: v1(44.32,33.26) 44.32,23.91 45.52,22.71 R24.1 R25.2 45.52,20.89 U17.7
  SN_IMT w0.381: 37.34,47.74 35.56,47.74 34.93,48.38 34.93,51.81 34.04,52.69 v1(29.12,52.69)
  POWER w0.381: v1(37.38,47.73) 41.03,47.73 44.32,44.44 v1(44.32,33.26)
PA7: length 50.4
  SN_IMT w0.381: 32.89,47.74 28.07,47.74 26.03,45.71 26.03,3.04
  vias: v1(32.98,47.73)
PA8: length 56.2
  Top Layer w0.203: 48.9,76.7 57.15,68.44 57.15,67.17 59.06,65.27 v1(59.82,65.27) ; v1(66.17,33.39) 66.11,33.33 CN1.53
  SN_IMT w0.381: v1(59.82,65.27) 62.61,62.47 64.13,62.47 69.09,57.52 69.09,36.31 v1(66.17,33.39)
PA9: length 61.8
  SN_IMT w0.381: v1(60.07,34.15) 61.72,35.8 65.41,35.8 67.18,37.58 67.18,46.09 65.66,47.61 65.66,54.73 61.34,59.05 v1(61.34,61.34)
  Bottom Layer w0.203: H3.3 69.72,26.03 61.59,34.15 v1(60.07,34.15)
PA10: length 56.5
  SN_IMT w0.381: v1(64.26,34.15) 65.66,34.15 67.82,36.31 67.82,46.22 66.29,47.74 66.29,56.5 64.13,58.66 v1(64.13,61.34)
  Bottom Layer w0.203: H3.2 72.26,12.94 70.36,14.85 70.36,28.06 v1(64.26,34.15)
PA11: length 111.6
  Top Layer w0.203: v1(58.55,34.92) 59.8,34.92 CN1.50 ; v1(25.27,19.29) 27.18,19.29 28.32,18.15 v1(30.73,18.15) ; v1(22.61,27.68) 17.02,33.26 v1(17.02,33.64) ; v1(35.18,18.28) 35.18,22.98 38.74,26.53 v1(42.42,26.53)
  SN_IMT w0.381: 13.33,76.7 17.78,72.25 17.78,34.41 v1(17.02,33.64) ; v1(56.01,31.23) 56.01,28.82 54.1,26.91 42.8,26.91 v1(42.42,26.53)
  POWER w0.381: v1(56.01,31.23) 56.01,33.39 57.53,34.92 v1(58.55,34.92)
  Bottom Layer w0.203: v1(35.18,18.28) 35.05,18.15 v1(30.73,18.15) ; v1(22.61,27.68) 22.61,19.93 23.24,19.29 v1(25.27,19.29)
PA12: length 27.7
  Top Layer w0.203: v1(65.91,45.96) 65.91,58.03 65.28,58.66 v1(62.9,58.66)
  Bottom Layer w0.203: v1(65.91,45.96) 65.91,35.55 65.28,34.92 64.26,34.92
  vias: v1(64.22,34.94)
PA15: length 71.9
  SN_IMT w0.381: v1(59.06,36.57) 56.64,36.57 54.74,38.47 53.59,38.47 v1(52.2,39.87)
  SN_NRM w0.381: v1(52.2,39.87) 51.44,39.87 44.58,46.73 44.58,50.03 v1(45.72,51.17) ; 18.42,76.7 22.61,72.51 42.16,72.51 43.43,71.24 43.43,59.68 v1(44.83,58.28)
  Bottom Layer w0.203: v1(44.83,58.28) 44.83,56.25 45.72,55.36 v1(45.72,51.17)
PB0: length 50.4
  Top Layer w0.203: v1(44.96,35.8) 43.94,36.82 43.94,38.85 39.88,42.92 39.88,45.71 39.45,46.14 37.38,46.14
  SN_NRM w0.381: U25.14 46.35,11.8 48.77,14.21 48.77,23.48 v1(48.26,23.99)
  Bottom Layer w0.203: v1(48.26,23.99) 47.62,23.99 44.96,26.66 v1(44.96,35.8)
PB1: length 49.9
  SN_NRM w0.381: v1(32.89,46.09) 29.59,46.09 28.45,44.95 v1(28.45,16.88)
  Bottom Layer w0.203: 20.95,3.04 28.45,10.53 v1(28.45,16.88)
PB3: length 39.9
  Top Layer w0.203: v1(58.04,43.04) 57.86,43.22 49.09,43.22 v1(45.72,46.6)
  SN_IMT w0.381: v1(45.72,46.6) 35.81,46.6 34.42,48 34.42,50.16 33.53,51.04 v1(29.12,51.04)
  POWER w0.381: v1(58.04,43.04) 63.5,43.04 v1(64.13,43.68)
PB4: length 48
  SN_IMT w0.381: v1(54.36,51.17) 53.85,51.68 53.85,61.71 53.09,62.47 45.34,62.47 43.43,64.38 43.43,66.92 33.66,76.7
  SN_NRM w0.381: v1(60.2,44.57) 59.69,44.57 54.36,49.9 v1(54.36,51.17)
PB5: length 19.8
  Top Layer w0.203: CN1.25 65.32,44.53 66.55,45.77 66.55,58.16 64.39,60.31 v1(62.87,60.31)
PB6: length 45.3
  SN_IMT w0.381: U24.13 47.12,65.78 53.47,65.78 55.12,64.12 v1(55.12,50.16)
  SN_NRM w0.381: v1(60.32,45.33) 59.94,45.33 v1(55.12,50.16)
PB7: length 8.9
  SN_NRM w0.381: v1(71.72,41.01) 67.4,45.33 v1(64.64,45.33)
PB10: length 75.7
  Top Layer w0.203: v1(29.59,19.04) 29.59,38.34 30.98,39.73 CN2.23 ; v1(63.36,7.74) 69.34,7.74 H5.3
  Bottom Layer w0.203: 63.25,7.74 62.48,8.5 45.73,8.5 ; 45.73,8.5 30.86,8.5 29.41,9.95 29.41,18.86 v1(29.59,19.04) ; 45.73,8.5 R31.1
PB11: length 75.9
  Top Layer w0.203: v1(30.23,19.04) 30.23,25.9 34.8,30.47 34.8,37.07 v1(35.31,37.58) ; v1(63.36,10.02) 70.36,10.02 H5.2
  Bottom Layer w0.203: 63.37,9.9 63.25,9.9 62.36,9.01 51.57,9.01 R30.1 49.92,10.66 30.99,10.66 29.97,11.67 29.97,18.79 v1(30.23,19.04) ; v1(37.97,38.98) 36.7,38.98 v1(35.31,37.58)
PB13: length 45.2
  Top Layer w0.203: v1(39.62,37.33) 38.82,38.14 37.38,38.14 ; v1(38.23,21.45) v1(38.23,5.96)
  Bottom Layer w0.203: v1(39.62,37.33) 38.74,36.44 38.74,35.55 37.97,34.79 35.61,34.79 35.18,34.36 35.18,33.9 38.23,30.85 v1(38.23,21.45) ; U25.15 42.04,4.82 39.37,4.82 v1(38.23,5.96)
PB14: length 47.3
  Top Layer w0.203: 18.42,3.04 20.95,5.58 30.35,5.58 31.88,7.1 31.88,24.88 v1(31.12,25.64)
  SN_NRM w0.381: v1(31.12,25.64) 31.12,37.45 31.75,38.09 v1(32.38,38.09)
PB15: length 39.5
  Top Layer w0.203: v1(38.74,19.68) 38.74,5.58 41.28,3.04
  SN_NRM w0.381: v1(39.75,30.09) 38.48,30.09 35.05,33.52 35.05,36.44 35.94,37.33 v1(36.58,37.33)
  Bottom Layer w0.203: v1(39.75,30.09) 39.75,24.25 38.74,23.23 v1(38.74,19.68)
PC1: length 90.1
  Top Layer w0.203: v1(24.77,9.01) 26.92,6.85 v1(28.45,6.85)
  SN_NRM w0.381: v1(37.21,51.68) 36.45,52.44 31.5,52.44 23.62,44.57 23.62,20.94 24,20.56 24,9.77 v1(24.77,9.01)
  Bottom Layer w0.203: U25.10 52.07,7.48 30.86,7.48 29.46,8.88 28.7,8.88 28.45,8.63 v1(28.45,6.85)
PC2: length 53.1
  POWER w0.381: 33.66,3.04 29.97,6.72 29.97,17.26 28.96,18.28 28.96,49.39 31.24,51.68 v1(32.77,51.68)
PC3: length 91.9
  Top Layer w0.203: v1(35.94,54.98) 35.94,51.17 36.19,50.92 37.36,50.92 CN2.52 ; v1(25.27,16.88) 27.05,16.88 v1(28.96,14.98)
  SN_IMT w0.381: v1(28.96,14.98) 28.96,11.42 v1(33.91,6.47) ; v1(25.27,16.88) 23.24,18.91 23.24,52.19 26.03,54.98 v1(35.94,54.98)
  Bottom Layer w0.203: U25.11 50.55,6.47 v1(33.91,6.47)
PC4: length 55.1
  Top Layer w0.203: v1(46.48,40.88) 45.09,42.28 45.09,44.44 42.67,46.85 37.46,46.85 CN2.42
  POWER w0.381: v1(46.48,34.41) v1(46.48,40.88)
  SN_NRM w0.381: 48.9,3.04 48.9,4.56 47.24,6.21 47.24,10.02 50.42,13.2 50.42,17.64 49.4,18.66 49.4,24.25 v1(48.77,24.88)
  Bottom Layer w0.203: v1(48.77,24.88) 47.5,24.88 46.48,25.9 v1(46.48,34.41)
PC5: length 49.8
  SN_IMT w0.381: v1(27.69,8.12) 27.69,45.58 28.96,46.85 v1(32.64,46.85)
  Bottom Layer w0.203: 23.5,3.04 27.69,7.23 v1(27.69,8.12)
PC6: length 13
  Top Layer w0.203: CN1.57 64.22,31.74 67.82,31.74 71.38,28.18 R38.1
PC7: length 112.6
  Top Layer w0.203: v1(36.07,17.52) 36.07,23.1 38.86,25.9 v1(41.91,25.9) ; v1(19.43,27.68) 15.88,31.23 v1(15.88,33.64) ; v1(30.73,17.52) 27.94,17.52 26.67,18.79 v1(25.02,18.79)
  SN_IMT w0.381: v1(59.69,32.5) 58.04,32.5 56.77,31.23 56.77,28.56 54.48,26.28 43.18,26.28 42.8,25.9 v1(41.91,25.9) ; 10.8,76.7 17.02,70.47 17.02,34.79 v1(15.88,33.64)
  Bottom Layer w0.203: v1(30.73,17.52) v1(36.07,17.52) ; v1(25.02,18.79) 22.86,18.79 21.97,19.68 21.97,25.77 20.07,27.68 v1(19.43,27.68)
PC8: length 45
  Top Layer w0.203: v1(51.31,43.93) 51.27,43.93 40.77,54.44 40.77,61.58 40.34,62.01 U6.7 38.99,61.46 v1(38.35,61.46)
  SN_NRM w0.381: v1(64.13,32.5) 56.13,40.5 56.13,41.9 54.86,43.17 52.07,43.17 v1(51.31,43.93)
  Bottom Layer w0.203: R5.1 37.84,61.46 v1(38.35,61.46)
PC9: length 39.6
  Top Layer w0.203: v1(36.96,60.82) 39.45,60.82 U6.8 40.04,60.91 40.13,60.82 40.13,53.71 v1(45.34,48.5)
  SN_NRM w0.381: v1(45.34,48.5) 45.59,48.5 52.96,41.14 52.96,39.36 59.06,33.26 v1(59.82,33.26)
PC10: length 53.9
  Top Layer w0.203: v1(62.36,47.61) 62.36,54.22 58.55,58.03 58.55,61.84 51.78,68.61 v1(39.54,68.61)
  SN_NRM w0.381: v1(64.64,36.57) 65.15,37.07 65.15,38.47 64.64,38.98 63.63,38.98 62.36,40.25 v1(62.36,47.61)
  Bottom Layer w0.203: R8.1 38.6,68.57 39.5,68.57
PC11: length 47.9
  Top Layer w0.203: CN1.44 59.82,37.33 61.21,37.33 61.59,37.71 v1(61.59,40.76)
  SN_IMT w0.381: v1(39.5,67.55) 40.89,67.55 42.04,66.41 42.04,55.74 47.37,50.41 v1(51.56,50.41)
  SN_NRM w0.381: v1(61.59,40.76) 61.21,40.76 v1(51.56,50.41)
  Bottom Layer w0.203: v1(39.5,67.55) 39.11,67.55 R7.1
PC12: length 40.9
  Top Layer w0.203: U6.5 40.68,64.21 41.4,63.49 41.4,54.73 v1(45.85,50.28)
  SN_NRM w0.381: 64.13,37.33 62.87,37.33 59.18,41.01 58.04,41.01 53.97,45.08 51.05,45.08 v1(45.85,50.28)
  vias: v1(64.22,37.33)
